# EasyEDA Pro project ProProject_Avaota Pi A_2024-03-25.epro, board PCB7 (continued)
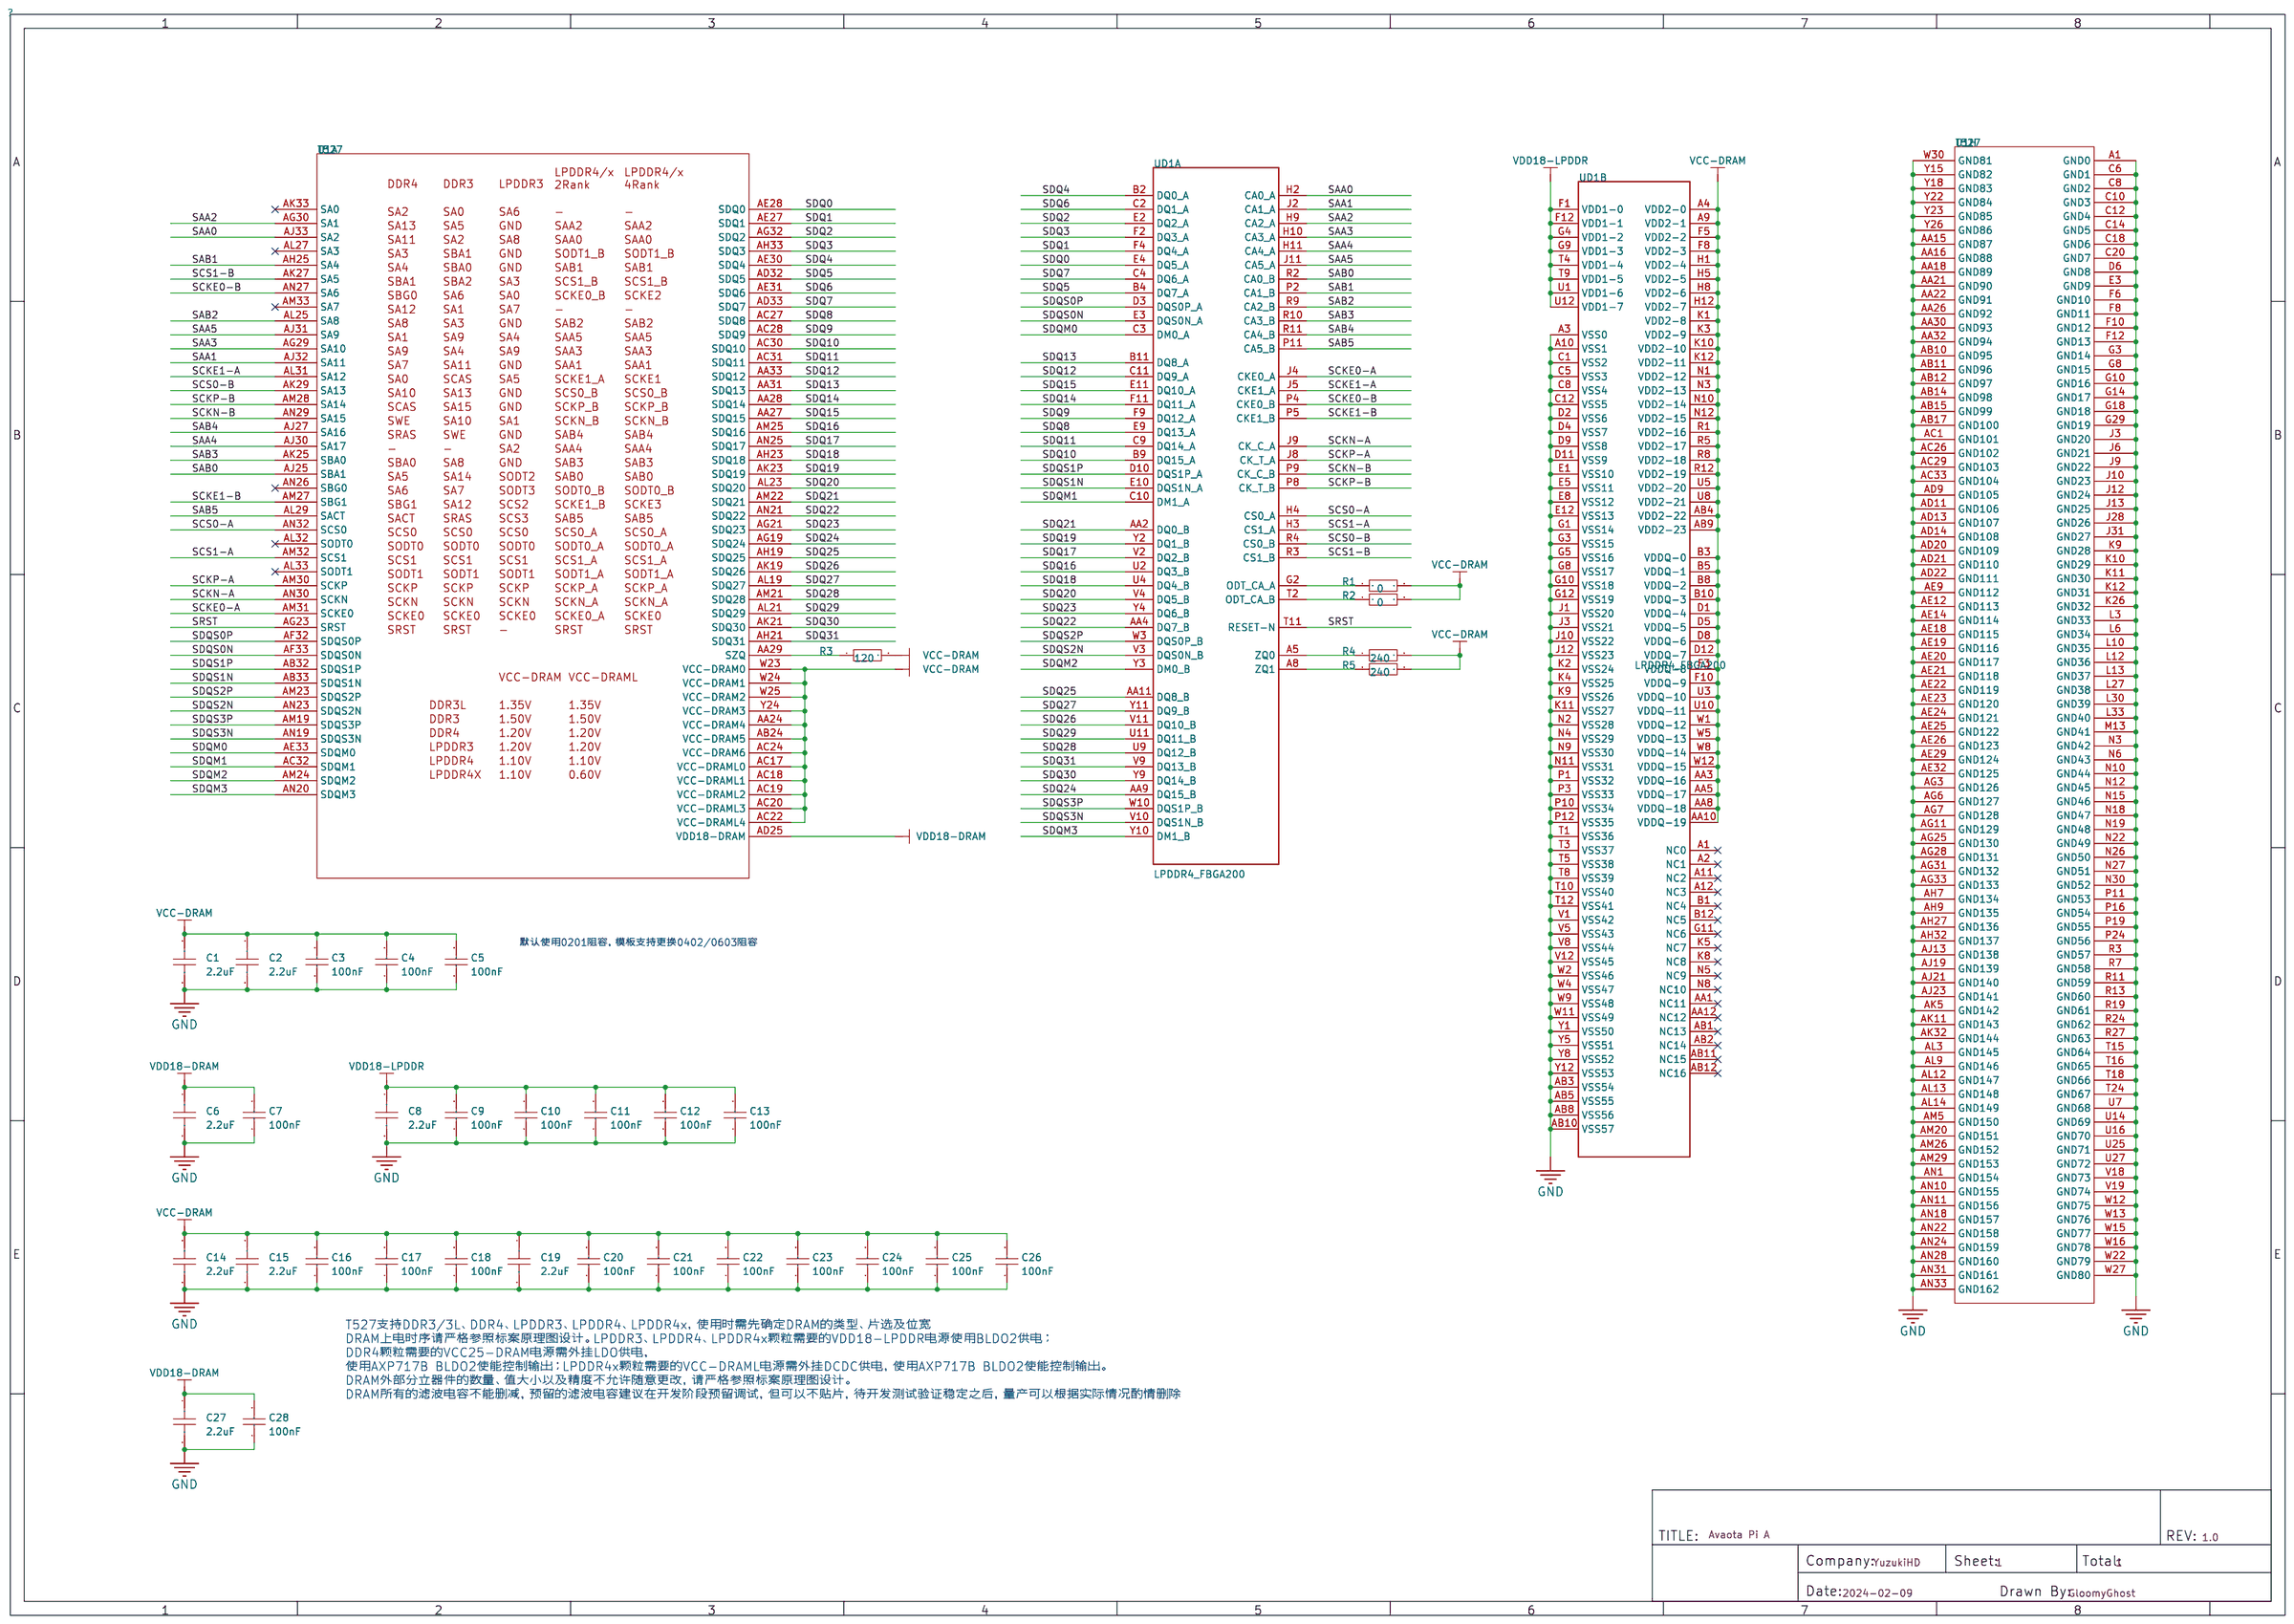
[diagram p0: schematic sheet]
## Routing (per net, layer and track width the routed paths; a pad name or vN(x,y) marks a point on that pad's centre or on a via; arc(x,y) is an arc through that point) (continued)
SDQ16: length 16.9
  Top Layer w0.076: 21.22,16.22 20.21,16.22 19.89,15.9 19.44,15.9 U1.AM25
  Top Layer w0.115: v1(29.74,9.58) 29.74,9.04 29.98,8.81 31.43,8.81 31.72,9.09 ; 21.22,16.22 21.33,16.33 23.85,16.33 v1(25.86,14.33)
  Inner2 w0.115: v1(25.86,14.33) 25.86,14.31 27.09,13.08 27.09,12.15 29.67,9.58 v1(29.74,9.58)
SDQ17: length 16.5
  Top Layer w0.115: 31.72,8.44 31.38,8.11 30.12,8.11 v1(29.79,8.43) ; U1.AN25 19.99,15.65 20.24,15.9 21.26,15.9 21.44,16.08 23.55,16.08 25.1,14.53 25.1,14.35 v1(25.12,14.33)
  Inner2 w0.115: v1(25.12,14.33) 25.25,14.33 26.67,12.9 26.67,11.98 29.79,8.86 v1(29.79,8.43)
SDQ18: length 24
  Top Layer w0.076: 17.19,14.65 17.19,15.04 v1(17.12,15.11)
  Top Layer w0.115: 33.32,9.09 33.42,9.08 v1(33.73,8.66)
  Inner2 w0.115: v1(17.12,15.11) 17.74,14.49 18.83,14.49 19.51,13.82 19.51,13.44 21.29,11.66 21.67,11.66 26.92,6.4 33.73,6.4 33.98,6.65 33.98,8.41 v1(33.73,8.66)
SDQ19: length 18.8
  Top Layer w0.115: v1(26.39,8) 27.06,8.67 29.16,8.67 29.4,8.43 29.4,7.3 29.83,6.87 31.41,6.87 31.68,7.14 31.72,7.14 ; U1.AK23 18.16,14.68 v1(18.16,15.11)
  Inner2 w0.115: v1(18.16,15.11) 18.16,15.01 18.44,14.73 19.2,14.73 19.63,14.3 19.76,14.3 22.58,11.48 22.92,11.48 26.39,8.01 v1(26.39,8)
SDQ20: length 21.2
  Top Layer w0.076: v1(33.63,6.81) 33.63,8.13 33.32,8.44
  Top Layer w0.102: 18.69,14.65 v1(18.69,15.11)
  Inner2 w0.115: v1(33.63,6.81) 33.6,6.78 27.23,6.78 26.81,7.2 26.81,8.18 23.12,11.87 22.78,11.87 20.1,14.55 19.76,14.55 19.2,15.11 v1(18.69,15.11)
SDQ21: length 17.3
  Top Layer w0.076: U1.AM22 19.44,13.9 19.82,13.9 19.86,13.94 20.77,13.94 v1(21.16,14.33)
  Top Layer w0.115: 31.72,6.49 31.64,6.49 31.22,6.07 31.22,5.74 31.05,5.57 30.65,5.57 30.28,5.94 29.49,5.94 27.51,7.92 27.39,7.92 27.28,8.04 v1(27.28,8.13)
  Inner2 w0.115: v1(21.16,14.33) 21.16,14.15 23.01,12.29 23.29,12.29 27.28,8.31 v1(27.28,8.13)
SDQ22: length 20.6
  Top Layer w0.076: 21.52,13.8 20.91,13.8 20.9,13.79 19.96,13.79 19.82,13.65 U1.AN21
  Top Layer w0.115: 33.32,6.49 32.97,6.14 32.97,5.28 32.49,4.8 30.33,4.8 29.57,5.56 29.39,5.56 27.71,7.24 v1(27.3,7.24) ; v1(21.74,14.33) 21.69,14.33 21.67,14.3 21.67,13.94 21.52,13.8
  Inner2 w0.115: v1(27.3,7.24) 27.7,7.63 27.7,8.48 23.47,12.71 23.19,12.71 21.74,14.16 v1(21.74,14.33)
SDQ23: length 22.1
  Top Layer w0.102: v1(16.58,14.07) 16.59,14.07 16.69,13.97 16.69,13.9 ; 16.69,13.9 U1.AG21 ; 16.69,13.9 16.69,13.65
  Top Layer w0.115: v1(30.28,5.36) 30.4,5.36 30.53,5.23 31.01,5.23 31.45,5.66 31.45,5.97 31.65,6.17 31.83,6.17 32.13,6.48 32.13,6.55 32.41,6.83 32.82,6.83 33.13,7.14 33.32,7.14
  Inner2 w0.115: v1(16.58,14.07) 16.69,14.07 16.98,13.78 16.98,13.78 17.09,13.67 18.69,13.67 21.16,11.2 21.54,11.2 27.38,5.36 v1(30.28,5.36)
SDQ24: length 25.9
  Top Layer w0.102: v1(16.58,13.11) 16.69,13.01 16.69,12.65
  Top Layer w0.115: 37.32,6.49 36.96,6.13 v1(36.96,6.1)
  Inner5 w0.115: v1(16.58,13.11) 16.58,12.9 17.35,12.14 17.89,12.14 18.62,11.42 18.62,11.4 18.92,11.1 21.61,11.1 23.75,8.97 23.75,8.81 27.75,4.8 35.71,4.8 36.25,5.33 36.25,5.74 36.53,6.02 36.88,6.02 v1(36.96,6.1)
SDQ25: length 27.2
  Top Layer w0.115: v1(35.43,5.18) 35.74,4.88 38,4.88 38.56,5.44 38.56,6.13 38.92,6.49 ; 17.12,12.72 U1.AH19 ; 17.12,12.72 v1(17.12,13.11)
  Inner5 w0.115: v1(35.43,5.18) 35.05,5.56 34.32,5.56 34.09,5.33 32.77,5.33 32.4,5.7 27.44,5.7 24.17,8.98 24.17,9.21 22,11.38 19.25,11.38 18.11,12.52 17.6,12.52 17.12,13.01 v1(17.12,13.11)
SDQ26: length 27
  Top Layer w0.102: 18.19,12.65 18.19,13.08 v1(18.16,13.11)
  Top Layer w0.115: 38.92,8.44 38.56,8.08 v1(38.56,8.08)
  Inner5 w0.115: v1(18.16,13.11) 18.16,13.06 19.53,11.68 22.28,11.68 24.59,9.38 24.59,9.27 27.74,6.12 32.46,6.12 32.82,5.77 34.04,5.77 34.16,5.89 35.1,5.89 35.33,6.12 36.16,6.12 36.54,6.5 37.95,6.5 38.07,6.38 38.68,6.38 38.91,6.6 38.91,7.72 v1(38.56,8.08)
SDQ27: length 24.4
  Top Layer w0.115: 38.92,7.14 38.56,6.78 v1(38.53,6.78) ; 18.69,12.65 v1(18.69,13.11)
  Inner5 w0.115: v1(18.69,13.11) 19.36,12.45 22.11,12.45 26.18,8.38 26.57,8.38 26.82,8.13 26.82,8 27.13,7.7 27.51,7.7 28.64,6.57 31.18,6.57 31.32,6.43 32.66,6.43 33.02,6.07 33.91,6.07 34.01,6.17 35.05,6.17 35.31,6.43 35.58,6.43 35.74,6.58 35.74,6.83 35.86,6.96 38.35,6.96 v1(38.53,6.78)
SDQ28: length 21.8
  Top Layer w0.076: 21.96,13.46 21.59,13.46 21.42,13.63 20.03,13.63 19.8,13.4 19.44,13.4 U1.AM21
  Top Layer w0.115: v1(25.85,12.6) 25.85,12.83 24.79,13.89 23.98,13.89 23.83,13.74 23.04,13.74 22.76,13.46 21.96,13.46 ; v1(35.48,9.04) 36.09,9.04 36.37,8.76 36.83,8.76 37.16,9.09 37.32,9.09
  Inner5 w0.115: v1(25.85,12.6) 25.87,12.6 26.49,11.97 26.49,11.63 27.04,11.09 28.14,11.09 28.74,10.49 29.03,10.49 29.26,10.72 29.65,10.72 30.01,10.36 30.58,10.36 31.09,9.86 31.57,9.86 31.65,9.78 32.44,9.78 32.64,9.58 33.25,9.58 33.5,9.83 33.96,9.83 34.29,9.5 35.37,9.5 35.48,9.39 v1(35.48,9.04)
SDQ29: length 25
  Top Layer w0.115: v1(39.32,8.84) 39.07,9.09 38.92,9.09 ; 18.69,13.65 v1(18.69,14.11)
  Inner5 w0.115: v1(39.32,8.84) 38.94,9.22 38.94,10.35 38.82,10.46 36.63,10.46 36.45,10.29 34.32,10.29 34.09,10.06 33.27,10.06 33.06,9.84 32.75,9.84 32.54,10.06 31.88,10.06 31.7,10.24 31.22,10.24 30.67,10.78 30.18,10.78 29.82,11.14 29.2,11.14 28.83,11.51 27.56,11.51 25.98,13.08 25.35,13.08 24.93,13.5 20.94,13.5 20.54,13.91 19.37,13.91 19.16,14.11 v1(18.69,14.11)
SDQ30: length 23.2
  Top Layer w0.102: v1(34.65,7.24) 34.67,7.21 35.41,7.21 35.76,6.86 36.7,6.86 36.96,7.11 37.29,7.11 37.32,7.14 ; v1(18.16,14.11) 18.19,14.08 18.19,13.65
  Inner5 w0.115: v1(34.65,7.24) 34.16,7.24 34.09,7.32 32.89,7.32 32.64,7.06 31.9,7.06 31.72,7.24 31.72,7.57 31.47,7.82 28.84,7.82 27.31,9.35 26.4,9.35 22.61,13.13 20.88,13.13 20.47,13.54 19.38,13.54 19.14,13.77 18.5,13.77 v1(18.16,14.11)
SDQ31: length 24.9
  Top Layer w0.115: 37.32,8.44 36.99,8.44 36.66,8.11 35.82,8.11 35.33,7.62 v1(35.33,7.59) ; v1(17.12,14.11) 17.12,13.72
  Inner5 w0.115: v1(35.33,7.59) 35.33,7.37 34.85,6.88 34.23,6.88 34.11,6.77 34.11,6.68 33.83,6.4 33.27,6.4 32.94,6.73 31.6,6.73 31.34,6.99 29.08,6.99 27.23,8.84 26.31,8.84 22.38,12.78 19.63,12.78 18.87,13.54 17.6,13.54 17.12,14.02 v1(17.12,14.11)
SDQM0: length 19.5
  Top Layer w0.076: v1(16.52,20.79) 15.73,20 15.73,19.82 15.69,19.78 15.69,19.65 U1.AE33
  Top Layer w0.115: v1(32.23,18.52) 32.23,18.48 32.52,18.19
  Inner2 w0.115: v1(32.23,18.52) 32.23,18.59 31.45,19.38 31.45,19.76 29.64,21.57 17.25,21.57 16.52,20.84 16.52,20.79 v1(16.52,20.79)
SDQM1: length 26.3
  Top Layer w0.115: 38.12,18.19 37.8,18.19 37.49,17.88 36.22,17.88 36.12,17.98 35.36,17.98 v1(35.23,17.86) ; v1(15.19,18.64) 14.69,19.14 U1.AC32
  Inner5 w0.115: v1(35.23,17.86) 35.38,17.7 35.38,17.48 35.08,17.17 33.48,17.17 32.99,17.65 32.03,17.65 31.06,18.62 30.68,18.62 30.29,18.23 29.15,18.23 28.78,17.86 26.97,17.86 26.23,18.61 21.58,18.61 20.93,19.25 15.8,19.25 v1(15.19,18.64)
SDQM2: length 19.9
  Top Layer w0.076: U1.AM24 19.44,15.4 20.1,15.4 20.35,15.65 21.34,15.65
  Top Layer w0.115: v1(28.98,8.26) 28.98,7.09 29.67,6.4 30.51,6.4 30.68,6.22 31.05,6.22 31.56,6.73 31.58,6.73 31.68,6.83 32.11,6.83 32.42,7.14 32.52,7.14 ; 21.34,15.65 21.49,15.65 21.67,15.82 23.38,15.82 24.59,14.62 v1(24.59,14.33)
  Inner2 w0.115: v1(28.98,8.26) 29.01,8.28 29.01,9.04 28.96,9.09 28.96,9.1 26.24,11.82 26.24,12.74 25.49,13.49 25.42,13.49 v1(24.59,14.33)
SDQM3: length 23.5
  Top Layer w0.076: 21.59,13.18 21.32,13.44 21.12,13.44 21.12,13.45 20.86,13.45 20.85,13.44 20.07,13.44 19.78,13.15 U1.AN20
  Top Layer w0.115: 38.12,7.14 38.18,7.14 v1(38.51,7.47) ; v1(25.86,12.01) 25.76,12.01 25.37,12.4 25.37,12.9 24.69,13.59 24.13,13.59 24.05,13.51 23.22,13.51 22.88,13.18 21.59,13.18
  Inner5 w0.115: v1(38.51,7.47) 38.13,7.85 38.13,8.31 37.47,8.97 35.97,8.97 35.69,8.69 34.8,8.69 34.42,9.07 33.5,9.07 33.35,9.22 32.64,9.22 32.46,9.04 31.17,9.04 30.81,9.4 30.81,9.6 30.47,9.94 28.7,9.94 27.97,10.67 26.95,10.67 26.11,11.51 26.11,11.76 v1(25.86,12.01)
SDQS0N: length 19.7
  Top Layer w0.076: U1.AF33 16.24,19.7 16.24,19.85 16.53,20.14 16.76,20.14 17.04,20.42 17.45,20.42 17.59,20.56 v1(17.59,20.76)
  Top Layer w0.097: v1(32.19,17.22) 32.52,16.89
  Inner2 w0.127: v1(17.59,20.76) 17.59,20.61 18.09,20.1 20.87,20.1 21.03,20.27 24.58,20.27 24.79,20.06 29.89,20.06 30.59,19.36 30.59,19.11 31.91,17.79 32.32,17.79 32.5,17.61 32.5,17.35 32.37,17.22 v1(32.19,17.22)
SDQS0P: length 20.1
  Top Layer w0.076: U1.AF32 16.19,19.29 16.43,19.53 16.43,19.76 16.61,19.94 16.85,19.94 17.13,20.22 17.6,20.22 v1(18.15,20.76)
  Top Layer w0.127: v1(32.87,17.22) 32.55,17.54 32.52,17.54
  Inner2 w0.127: v1(32.87,17.22) 32.79,17.3 32.79,17.74 32.44,18.08 32.03,18.08 30.89,19.23 30.89,19.48 30.02,20.35 24.92,20.35 24.71,20.56 20.91,20.56 20.75,20.4 18.52,20.4 v1(18.15,20.76)
SDQS1N: length 30.2
  Top Layer w0.076: U1.AB33 14.19,20.53 v1(13.89,20.83)
  Top Layer w0.127: v1(38.43,17.22) 38.12,16.91 38.12,16.89
  Inner5 w0.127: v1(13.89,20.83) 13.94,20.88 13.94,21.2 14.24,21.49 36.95,21.49 38.11,20.33 38.11,17.82 38.33,17.6 38.33,17.33 38.43,17.22 v1(38.43,17.22)
SDQS1P: length 30.3
  Top Layer w0.076: v1(14.45,20.83) 14.45,20.7 14.44,20.69 14.44,20.53 14.52,20.45 14.65,20.45 14.75,20.36 14.75,20.25 14.65,20.15 14.52,20.15 14.44,20.07 14.44,19.4 U1.AB32
  Top Layer w0.127: v1(37.8,17.22) 38.12,17.54
  Inner5 w0.127: v1(37.8,17.22) 37.91,17.22 38.04,17.35 38.04,17.48 37.82,17.7 37.82,20.21 36.83,21.2 14.36,21.2 14.24,21.08 14.24,20.96 14.36,20.83 v1(14.45,20.83)
SDQS2N: length 18.8
  Top Layer w0.076: U1.AN23 19.69,14.76 19.77,14.84 19.88,14.84 19.95,14.76 19.95,14.68 20.03,14.6 20.34,14.6 20.93,15.19 22.6,15.19
  Top Layer w0.127: v1(32.13,8.03) 32.13,8.05 32.52,8.44 ; v1(23.47,14.33) 23.37,14.33 23.19,14.5 23.19,14.86 22.87,15.19 22.6,15.19
  Inner2 w0.127: v1(32.13,8.03) 32.13,7.96 32,7.84 31.85,7.84 31.63,8.05 29.59,8.05 29.22,7.68 28.77,7.68 28.49,7.96 28.49,8.85 25.44,11.9 25.44,12.77 24.33,13.87 23.41,13.87 23.23,14.05 23.23,14.19 23.37,14.33 v1(23.47,14.33)
SDQS2P: length 18.8
  Top Layer w0.076: U1.AM23 19.44,14.4 20.43,14.4 21.01,14.98 22.33,14.98 22.43,14.88 22.54,14.88
  Top Layer w0.127: v1(22.89,14.33) 22.94,14.38 22.94,14.76 22.81,14.88 22.54,14.88 22.54,14.88 ; v1(32.13,7.44) 32.14,7.45 32.18,7.45 32.52,7.79
  Inner2 w0.127: v1(22.89,14.33) 22.94,14.27 22.94,13.93 23.29,13.58 24.21,13.58 25.15,12.64 25.15,11.78 28.2,8.72 28.2,7.84 28.64,7.39 29.34,7.39 29.71,7.76 31.51,7.76 31.72,7.54 32.03,7.54 v1(32.13,7.44)
SDQS3N: length 22.2
  Top Layer w0.076: U1.AN19 20.62,12.65 20.7,12.73 20.7,12.9 20.78,12.97 20.93,12.97 21.01,12.9 21.01,12.73 21.08,12.65 21.56,12.65
  Top Layer w0.127: 21.56,12.65 24.14,12.65 v1(24.38,12.89) ; 38.12,8.44 38.11,8.44 v1(37.77,8.1)
  Inner5 w0.127: v1(37.77,8.1) 37.77,7.98 37.64,7.85 37.45,7.85 37.2,8.09 35.91,8.09 35.74,8.26 35.07,8.26 34.74,7.92 33.32,7.92 32.56,8.69 31.11,8.69 30.66,9.14 28.73,9.14 27.71,10.16 26.71,10.16 25.48,11.39 25.48,12.24 24.98,12.74 24.54,12.74 24.39,12.89 v1(24.38,12.89)
SDQS3P: length 22.1
  Top Layer w0.076: 21.56,12.39 21.45,12.39 21.4,12.45 19.97,12.45 19.93,12.4 19.55,12.4 19.3,12.65 U1.AM19
  Top Layer w0.127: 21.56,12.39 24.37,12.39 v1(24.38,12.38) ; 38.12,7.79 38.09,7.79 v1(37.72,7.42)
  Inner5 w0.127: v1(24.38,12.38) 24.45,12.45 24.86,12.45 25.18,12.12 25.18,11.27 26.59,9.87 27.59,9.87 28.61,8.85 30.54,8.85 30.99,8.39 32.44,8.39 33.2,7.63 34.86,7.63 35.19,7.96 35.62,7.96 35.79,7.8 37.08,7.8 37.33,7.56 37.58,7.56 v1(37.72,7.42)
SRST: length 27.9
  Top Layer w0.076: U1.AG23 16.69,14.93 16.59,15.03 16.59,15.11 v1(16.57,15.13)
  Top Layer w0.102: 38.92,9.74 38.73,9.55 38.53,9.55 38.52,9.54 38.51,9.54 v1(38.49,9.53)
  Inner2 w0.115: v1(38.49,9.53) 37.86,8.89 36.37,8.89 35.76,9.5 34.67,9.5 34.24,9.07 33.27,9.07 33.12,9.22 32.66,9.22 32.41,8.97 31.19,8.97 30.89,9.27 30.89,9.5 28.91,11.48 28.36,11.48 27.53,12.3 27.53,12.78 27.81,13.06 27.81,13.46 27.58,13.69 27.15,13.69 25.91,14.94 20.95,14.94 20.42,15.47 17.91,15.47 17.86,15.52 16.95,15.52 v1(16.57,15.13)
$1N11425: length 1.3
  Top Layer w0.115: v1(13.23,17.67) 13.67,17.67 U1.AA29
  Bottom Layer w0.152: v1(13.23,17.67) 13.55,17.67 13.72,17.5 13.72,17.26 R3.1
$1N11433: length 1.4
  Top Layer w0.115: 34.12,19.49 34.12,19.51 v1(34.42,19.81)
  Bottom Layer w0.115: v1(34.42,19.81) 34.42,20.07 34.14,20.34 33.86,20.34
$1N11434: length 1.3
  Top Layer w0.115: v1(36.6,20.02) 36.52,19.93 36.52,19.49
  Bottom Layer w0.115: v1(36.6,20.02) 36.7,19.92 36.7,19.34
$1N11438: length 3.4
  Top Layer w0.115: 29.51,16.79 29.78,16.79 29.9,16.67 29.9,15.85 30.42,15.32 31.45,15.32 31.72,15.59
$1N11439: length 3
  Top Layer w0.115: 31.72,9.74 31.43,10.03 29.69,10.03 29.46,9.8 28.98,9.8 28.93,9.76

## Copper pours and planes (outline as drawn; the poured copper is in the pictures)
GND on Top Layer: -0.69,24.97 43.43,24.97 43.43,-0.97 -0.69,-0.97
GND on Bottom Layer: -0.59,24.92 43.53,24.92 43.53,-1.01 -0.59,-1.01
GND on Inner1: 12.6,14.3 14.02,14.3 14.33,13.99 14.33,11.56 15.14,10.74 21.31,10.74 27.76,4.29 40.69,4.29 41.2,4.8 41.2,20.27 38.25,23.21 13.97,23.21 12.32,21.56 12.32,14.58
GND on Inner1: 12.6,14.33 14.02,14.33 14.33,14.02 14.33,11.58 15.14,10.77 21.31,10.77 27.76,4.32 40.69,4.32 41.2,4.83 41.2,20.29 38.25,23.24 13.97,23.24 12.32,21.59 12.32,14.61
GND on Inner3: 12.59,14.31 14.01,14.31 14.31,14.01 14.31,11.57 15.13,10.76 21.3,10.76 27.75,4.31 40.68,4.31 41.19,4.81 41.19,20.28 38.24,23.23 13.96,23.23 12.31,21.58 12.31,14.59
GND on Inner6: 12.61,14.31 14.03,14.31 14.34,14.01 14.34,11.57 15.15,10.76 21.32,10.76 27.77,4.31 40.7,4.31 41.21,4.81 41.21,20.28 38.26,23.23 13.98,23.23 12.33,21.58 12.33,14.59
VCC-DRAM on Inner4: 12.6,14.34 14.03,14.34 14.33,14.03 14.33,11.6 15.14,10.78 21.32,10.78 27.77,4.33 40.7,4.33 41.2,4.84 41.2,20.31 38.26,23.25 13.97,23.25 12.32,21.6 12.32,14.62
VDD18-LPDDR on Bottom Layer: 29.9,20.8 28.46,19.37 28.46,5.88 29.82,4.52 39.79,4.52 41.1,5.84 41.1,19.65 39.95,20.8
